# EAGLE schematic Resistor_Resistor (EAGLE 8.3.0), part 2 of 43 (continued)
## Parts (continued)
R2209  10K  RESISTOR_0201  [0201]
R2210  10K  RESISTOR_0201  [0201]
R2211  10K  RESISTOR_0201  [0201]
R2212  10K  RESISTOR_0201  [0201]
R2213  10K  RESISTOR_0201  [0201]
R2214  10K  RESISTOR_0201  [0201]
R2215  10K  RESISTOR_0201  [0201]
R2216  10K  RESISTOR_0201  [0201]
R2217  10K  RESISTOR_0201  [0201]
R2218  10K  RESISTOR_0201  [0201]
R2219  10K  RESISTOR_0201  [0201]
R2220  10K  RESISTOR_0201  [0201]
R2221  10K  RESISTOR_0201  [0201]
R2222  10K  RESISTOR_0201  [0201]
R2223  10K  RESISTOR_0201  [0201]
R2224  10K  RESISTOR_0201  [0201]
R2225  10K  RESISTOR_0201  [0201]
R2226  10K  RESISTOR_0201  [0201]
R2227  10K  RESISTOR_0201  [0201]
R2228  10K  RESISTOR_0201  [0201]
R2229  10K  RESISTOR_0201  [0201]
R2230  10K  RESISTOR_0201  [0201]
R2231  10K  RESISTOR_0201  [0201]
R2232  10K  RESISTOR_0201  [0201]
R2233  10K  RESISTOR_0201  [0201]
R2234  10K  RESISTOR_0201  [0201]
R2235  10K  RESISTOR_0201  [0201]
R2236  10K  RESISTOR_0201  [0201]
R2237  10K  RESISTOR_0201  [0201]
R2238  10K  RESISTOR_0201  [0201]
R2239  10K  RESISTOR_0201  [0201]
R2240  10K  RESISTOR_0201  [0201]
R2241  10K  RESISTOR_0201  [0201]
R2242  10K  RESISTOR_0201  [0201]
R2243  10K  RESISTOR_0201  [0201]
R2244  10K  RESISTOR_0201  [0201]
R2245  10K  RESISTOR_0201  [0201]
R2246  10K  RESISTOR_0201  [0201]
R2247  10K  RESISTOR_0201  [0201]
R2248  10K  RESISTOR_0201  [0201]
R2249  10K  RESISTOR_0201  [0201]
R2250  10K  RESISTOR_0201  [0201]
R2251  10K  RESISTOR_0201  [0201]
R2252  10K  RESISTOR_0201  [0201]
R2253  10K  RESISTOR_0201  [0201]
R2254  10K  RESISTOR_0201  [0201]
R2255  10K  RESISTOR_0201  [0201]
R2256  10K  RESISTOR_0201  [0201]
R2257  10K  RESISTOR_0201  [0201]
R2258  10K  RESISTOR_0201  [0201]
R2259  10K  RESISTOR_0201  [0201]
R2260  10K  RESISTOR_0201  [0201]
R2261  10K  RESISTOR_0201  [0201]
R2262  10K  RESISTOR_0201  [0201]
R2263  10K  RESISTOR_0201  [0201]
R2264  10K  RESISTOR_0201  [0201]
R2265  10K  RESISTOR_0201  [0201]
R2266  10K  RESISTOR_0201  [0201]
R2267  10K  RESISTOR_0201  [0201]
R2268  10K  RESISTOR_0201  [0201]
R2269  10K  RESISTOR_0201  [0201]
R2270  10K  RESISTOR_0201  [0201]
R2271  10K  RESISTOR_0201  [0201]
R2272  10K  RESISTOR_0201  [0201]
R2273  10K  RESISTOR_0201  [0201]
R2274  10K  RESISTOR_0201  [0201]
R2275  10K  RESISTOR_0201  [0201]
R2276  10K  RESISTOR_0201  [0201]
R2277  10K  RESISTOR_0201  [0201]
R2278  10K  RESISTOR_0201  [0201]
R2279  10K  RESISTOR_0201  [0201]
R2280  10K  RESISTOR_0201  [0201]
R2281  10K  RESISTOR_0201  [0201]
R2282  10K  RESISTOR_0201  [0201]
R2283  10K  RESISTOR_0201  [0201]
R2284  10K  RESISTOR_0201  [0201]
R2285  10K  RESISTOR_0201  [0201]
R2286  10K  RESISTOR_0201  [0201]
R2287  10K  RESISTOR_0201  [0201]
R2288  10K  RESISTOR_0201  [0201]
R2289  10K  RESISTOR_0201  [0201]
R2290  10K  RESISTOR_0201  [0201]
R2291  10K  RESISTOR_0201  [0201]
R2292  10K  RESISTOR_0201  [0201]
R2293  10K  RESISTOR_0201  [0201]
R2294  10K  RESISTOR_0201  [0201]
R2295  10K  RESISTOR_0201  [0201]
R2296  10K  RESISTOR_0201  [0201]
R2297  10K  RESISTOR_0201  [0201]
R2298  10K  RESISTOR_0201  [0201]
R2299  10K  RESISTOR_0201  [0201]
R2300  10K  RESISTOR_0201  [0201]
R2301  10K  RESISTOR_0201  [0201]
R2302  10K  RESISTOR_0201  [0201]
R2303  10K  RESISTOR_0201  [0201]
R2304  10K  RESISTOR_0201  [0201]
R2305  10K  RESISTOR_0201  [0201]
R2306  10K  RESISTOR_0201  [0201]
R2307  10K  RESISTOR_0201  [0201]
R2308  10K  RESISTOR_0201  [0201]
R2309  10K  RESISTOR_0201  [0201]
R2310  10K  RESISTOR_0201  [0201]
R2311  10K  RESISTOR_0201  [0201]
R2312  10K  RESISTOR_0201  [0201]
R2313  10K  RESISTOR_0201  [0201]
R2314  10K  RESISTOR_0201  [0201]
R2315  10K  RESISTOR_0201  [0201]
R2316  10K  RESISTOR_0201  [0201]
R2317  10K  RESISTOR_0201  [0201]
R2318  10K  RESISTOR_0201  [0201]
R2319  10K  RESISTOR_0201  [0201]
R2320  10K  RESISTOR_0201  [0201]
R2321  10K  RESISTOR_0201  [0201]
R2322  10K  RESISTOR_0201  [0201]
R2323  10K  RESISTOR_0201  [0201]
R2324  10K  RESISTOR_0201  [0201]
R2325  10K  RESISTOR_0201  [0201]
R2326  10K  RESISTOR_0201  [0201]
R2327  10K  RESISTOR_0201  [0201]
R2328  10K  RESISTOR_0201  [0201]
R2329  10K  RESISTOR_0201  [0201]
R2330  10K  RESISTOR_0201  [0201]
R2331  10K  RESISTOR_0201  [0201]
R2332  10K  RESISTOR_0201  [0201]
R2333  10K  RESISTOR_0201  [0201]
R2334  10K  RESISTOR_0201  [0201]
R2335  10K  RESISTOR_0201  [0201]
R2336  10K  RESISTOR_0201  [0201]
R2337  10K  RESISTOR_0201  [0201]
R2338  10K  RESISTOR_0201  [0201]
R2339  10K  RESISTOR_0201  [0201]
R2340  10K  RESISTOR_0201  [0201]
R2341  10K  RESISTOR_0201  [0201]
R2342  10K  RESISTOR_0201  [0201]
R2343  10K  RESISTOR_0201  [0201]
R2344  10K  RESISTOR_0201  [0201]
R2345  10K  RESISTOR_0201  [0201]
R2346  10K  RESISTOR_0201  [0201]
R2347  10K  RESISTOR_0201  [0201]
R2348  10K  RESISTOR_0201  [0201]
R2349  10K  RESISTOR_0201  [0201]
R2350  10K  RESISTOR_0201  [0201]
R2351  10K  RESISTOR_0201  [0201]
R2352  10K  RESISTOR_0201  [0201]
R2353  10K  RESISTOR_0201  [0201]
R2354  10K  RESISTOR_0201  [0201]
R2355  10K  RESISTOR_0201  [0201]
R2356  10K  RESISTOR_0201  [0201]
R2357  10K  RESISTOR_0201  [0201]
R2358  10K  RESISTOR_0201  [0201]
R2359  10K  RESISTOR_0201  [0201]
R2360  10K  RESISTOR_0201  [0201]
R2361  10K  RESISTOR_0201  [0201]
R2362  10K  RESISTOR_0201  [0201]
R2363  10K  RESISTOR_0201  [0201]
R2364  10K  RESISTOR_0201  [0201]
R2365  10K  RESISTOR_0201  [0201]
R2366  10K  RESISTOR_0201  [0201]
R2367  10K  RESISTOR_0201  [0201]
R2368  10K  RESISTOR_0201  [0201]
R2369  10K  RESISTOR_0201  [0201]
R2370  10K  RESISTOR_0201  [0201]
R2371  10K  RESISTOR_0201  [0201]
R2372  10K  RESISTOR_0201  [0201]
R2373  10K  RESISTOR_0201  [0201]
R2374  10K  RESISTOR_0201  [0201]
R2375  10K  RESISTOR_0201  [0201]
R2376  10K  RESISTOR_0201  [0201]
R2377  10K  RESISTOR_0201  [0201]
R2378  10K  RESISTOR_0201  [0201]
R2379  10K  RESISTOR_0201  [0201]
R2380  10K  RESISTOR_0201  [0201]
R2381  10K  RESISTOR_0201  [0201]
R2382  10K  RESISTOR_0201  [0201]
R2383  10K  RESISTOR_0201  [0201]
R2384  10K  RESISTOR_0201  [0201]
R2385  10K  RESISTOR_0201  [0201]
R2386  10K  RESISTOR_0201  [0201]
R2387  10K  RESISTOR_0201  [0201]
R2388  10K  RESISTOR_0201  [0201]
R2389  10K  RESISTOR_0201  [0201]
R2390  10K  RESISTOR_0201  [0201]
R2391  10K  RESISTOR_0201  [0201]
R2392  10K  RESISTOR_0201  [0201]
R2393  10K  RESISTOR_0201  [0201]
R2394  10K  RESISTOR_0201  [0201]
R2395  10K  RESISTOR_0201  [0201]
R2396  10K  RESISTOR_0201  [0201]
R2397  10K  RESISTOR_0201  [0201]
R2398  10K  RESISTOR_0201  [0201]
R2399  10K  RESISTOR_0201  [0201]
R2400  10K  RESISTOR_0201  [0201]
R2401  10K  RESISTOR_0201  [0201]
R2402  10K  RESISTOR_0201  [0201]
R2403  10K  RESISTOR_0201  [0201]
R2404  10K  RESISTOR_0201  [0201]
R2405  10K  RESISTOR_0201  [0201]
R2406  10K  RESISTOR_0201  [0201]
R2407  10K  RESISTOR_0201  [0201]
R2408  10K  RESISTOR_0201  [0201]
R2409  10K  RESISTOR_0201  [0201]
R2410  10K  RESISTOR_0201  [0201]
R2411  10K  RESISTOR_0201  [0201]
R2412  10K  RESISTOR_0201  [0201]
R2413  10K  RESISTOR_0201  [0201]
R2414  10K  RESISTOR_0201  [0201]
R2415  10K  RESISTOR_0201  [0201]
R2416  10K  RESISTOR_0201  [0201]
R2417  10K  RESISTOR_0201  [0201]
R2418  10K  RESISTOR_0201  [0201]
R2419  10K  RESISTOR_0201  [0201]
R2420  10K  RESISTOR_0201  [0201]
R2421  10K  RESISTOR_0201  [0201]
R2422  10K  RESISTOR_0201  [0201]
R2423  10K  RESISTOR_0201  [0201]
R2424  10K  RESISTOR_0201  [0201]
R2425  10K  RESISTOR_0201  [0201]
R2426  10K  RESISTOR_0201  [0201]
R2427  10K  RESISTOR_0201  [0201]
R2428  10K  RESISTOR_0201  [0201]
R2429  10K  RESISTOR_0201  [0201]
R2430  10K  RESISTOR_0201  [0201]
R2431  10K  RESISTOR_0201  [0201]
R2432  10K  RESISTOR_0201  [0201]
R2433  10K  RESISTOR_0201  [0201]
R2434  10K  RESISTOR_0201  [0201]
R2435  10K  RESISTOR_0201  [0201]
R2436  10K  RESISTOR_0201  [0201]
R2437  10K  RESISTOR_0201  [0201]
R2438  10K  RESISTOR_0201  [0201]
R2439  10K  RESISTOR_0201  [0201]
R2440  10K  RESISTOR_0201  [0201]
R2441  10K  RESISTOR_0201  [0201]
R2442  10K  RESISTOR_0201  [0201]
R2443  10K  RESISTOR_0201  [0201]
R2444  10K  RESISTOR_0201  [0201]
R2445  10K  RESISTOR_0201  [0201]
R2446  10K  RESISTOR_0201  [0201]
R2447  10K  RESISTOR_0201  [0201]
R2448  10K  RESISTOR_0201  [0201]
R2449  10K  RESISTOR_0201  [0201]
R2450  10K  RESISTOR_0201  [0201]
R2451  10K  RESISTOR_0201  [0201]
R2452  10K  RESISTOR_0201  [0201]
R2453  10K  RESISTOR_0201  [0201]
R2454  10K  RESISTOR_0201  [0201]
R2455  10K  RESISTOR_0201  [0201]
R2456  10K  RESISTOR_0201  [0201]
R2457  10K  RESISTOR_0201  [0201]
R2458  10K  RESISTOR_0201  [0201]
R2459  10K  RESISTOR_0201  [0201]
R2460  10K  RESISTOR_0201  [0201]
R2461  10K  RESISTOR_0201  [0201]
R2462  10K  RESISTOR_0201  [0201]
R2463  10K  RESISTOR_0201  [0201]
R2464  10K  RESISTOR_0201  [0201]
R2465  10K  RESISTOR_0201  [0201]
R2466  10K  RESISTOR_0201  [0201]
R2467  10K  RESISTOR_0201  [0201]
R2468  10K  RESISTOR_0201  [0201]
R2469  10K  RESISTOR_0201  [0201]
R2470  10K  RESISTOR_0201  [0201]
R2471  10K  RESISTOR_0201  [0201]
R2472  10K  RESISTOR_0201  [0201]
R2473  10K  RESISTOR_0201  [0201]
R2474  10K  RESISTOR_0201  [0201]
R2475  10K  RESISTOR_0201  [0201]
R2476  10K  RESISTOR_0201  [0201]
R2477  10K  RESISTOR_0201  [0201]
R2478  10K  RESISTOR_0201  [0201]
R2479  10K  RESISTOR_0201  [0201]
R2480  10K  RESISTOR_0201  [0201]
R2481  10K  RESISTOR_0201  [0201]
R2482  10K  RESISTOR_0201  [0201]
R2483  10K  RESISTOR_0201  [0201]
R2484  10K  RESISTOR_0201  [0201]
R2485  10K  RESISTOR_0201  [0201]
R2486  10K  RESISTOR_0201  [0201]
R2487  10K  RESISTOR_0201  [0201]
R2488  10K  RESISTOR_0201  [0201]
R2489  10K  RESISTOR_0201  [0201]
R2490  10K  RESISTOR_0201  [0201]
R2491  10K  RESISTOR_0201  [0201]
R2492  10K  RESISTOR_0201  [0201]
R2493  10K  RESISTOR_0201  [0201]
R2494  10K  RESISTOR_0201  [0201]
R2495  10K  RESISTOR_0201  [0201]
R2496  10K  RESISTOR_0201  [0201]
R2497  10K  RESISTOR_0201  [0201]
R2498  10K  RESISTOR_0201  [0201]
R2499  10K  RESISTOR_0201  [0201]
R2500  10K  RESISTOR_0201  [0201]
R2501  10K  RESISTOR_0201  [0201]
R2502  10K  RESISTOR_0201  [0201]
R2503  10K  RESISTOR_0201  [0201]
R2504  10K  RESISTOR_0201  [0201]
R2505  10K  RESISTOR_0201  [0201]
R2506  10K  RESISTOR_0201  [0201]
R2507  10K  RESISTOR_0201  [0201]
R2508  10K  RESISTOR_0201  [0201]
R2509  10K  RESISTOR_0201  [0201]
R2510  10K  RESISTOR_0201  [0201]
R2511  10K  RESISTOR_0201  [0201]
R2512  10K  RESISTOR_0201  [0201]
R2513  10K  RESISTOR_0201  [0201]
R2514  10K  RESISTOR_0201  [0201]
R2515  10K  RESISTOR_0201  [0201]
R2516  10K  RESISTOR_0201  [0201]
R2517  10K  RESISTOR_0201  [0201]
R2518  10K  RESISTOR_0201  [0201]
R2519  10K  RESISTOR_0201  [0201]
R2520  10K  RESISTOR_0201  [0201]
R2521  10K  RESISTOR_0201  [0201]
R2522  10K  RESISTOR_0201  [0201]
R2523  10K  RESISTOR_0201  [0201]
R2524  10K  RESISTOR_0201  [0201]
R2525  10K  RESISTOR_0201  [0201]
R2526  10K  RESISTOR_0201  [0201]
R2527  10K  RESISTOR_0201  [0201]
R2528  10K  RESISTOR_0201  [0201]
R2529  10K  RESISTOR_0201  [0201]
R2530  10K  RESISTOR_0201  [0201]
R2531  10K  RESISTOR_0201  [0201]
R2532  10K  RESISTOR_0201  [0201]
R2533  10K  RESISTOR_0201  [0201]
R2534  10K  RESISTOR_0201  [0201]
R2535  10K  RESISTOR_0201  [0201]
R2536  10K  RESISTOR_0201  [0201]
R2537  10K  RESISTOR_0201  [0201]
R2538  10K  RESISTOR_0201  [0201]
R2539  10K  RESISTOR_0201  [0201]
R2540  10K  RESISTOR_0201  [0201]
R2541  10K  RESISTOR_0201  [0201]
R2542  10K  RESISTOR_0201  [0201]
R2543  10K  RESISTOR_0201  [0201]
R2544  10K  RESISTOR_0201  [0201]
R2545  10K  RESISTOR_0201  [0201]
R2546  10K  RESISTOR_0201  [0201]
R2547  10K  RESISTOR_0201  [0201]
R2548  10K  RESISTOR_0201  [0201]
R2549  10K  RESISTOR_0201  [0201]
R2550  10K  RESISTOR_0201  [0201]
R2551  10K  RESISTOR_0201  [0201]
R2552  10K  RESISTOR_0201  [0201]
R2553  10K  RESISTOR_0201  [0201]
R2554  10K  RESISTOR_0201  [0201]
R2555  10K  RESISTOR_0201  [0201]
R2556  10K  RESISTOR_0201  [0201]
R2557  10K  RESISTOR_0201  [0201]
R2558  10K  RESISTOR_0201  [0201]
R2559  10K  RESISTOR_0201  [0201]
R2560  10K  RESISTOR_0201  [0201]
R2561  10K  RESISTOR_0201  [0201]
R2562  10K  RESISTOR_0201  [0201]
R2563  10K  RESISTOR_0201  [0201]
R2564  10K  RESISTOR_0201  [0201]
R2565  10K  RESISTOR_0201  [0201]
R2566  10K  RESISTOR_0201  [0201]
R2567  10K  RESISTOR_0201  [0201]
R2568  10K  RESISTOR_0201  [0201]
R2569  10K  RESISTOR_0201  [0201]
R2570  10K  RESISTOR_0201  [0201]
R2571  10K  RESISTOR_0201  [0201]
R2572  10K  RESISTOR_0201  [0201]
R2573  10K  RESISTOR_0201  [0201]
R2574  10K  RESISTOR_0201  [0201]
R2575  10K  RESISTOR_0201  [0201]
R2576  10K  RESISTOR_0201  [0201]
R2577  10K  RESISTOR_0201  [0201]
R2578  10K  RESISTOR_0201  [0201]
R2579  10K  RESISTOR_0201  [0201]
R2580  10K  RESISTOR_0201  [0201]
R2581  10K  RESISTOR_0201  [0201]
R2582  10K  RESISTOR_0201  [0201]
R2583  10K  RESISTOR_0201  [0201]
R2584  10K  RESISTOR_0201  [0201]
R2585  10K  RESISTOR_0201  [0201]
R2586  10K  RESISTOR_0201  [0201]
R2587  10K  RESISTOR_0201  [0201]
R2588  10K  RESISTOR_0201  [0201]
R2589  10K  RESISTOR_0201  [0201]
R2590  10K  RESISTOR_0201  [0201]
R2591  10K  RESISTOR_0201  [0201]
R2592  10K  RESISTOR_0201  [0201]
R2593  10K  RESISTOR_0201  [0201]
R2594  10K  RESISTOR_0201  [0201]
R2595  10K  RESISTOR_0201  [0201]
R2596  10K  RESISTOR_0201  [0201]
R2597  10K  RESISTOR_0201  [0201]
R2598  10K  RESISTOR_0201  [0201]
R2599  10K  RESISTOR_0201  [0201]
R2600  10K  RESISTOR_0201  [0201]
R2601  10K  RESISTOR_0201  [0201]
R2602  10K  RESISTOR_0201  [0201]
R2603  10K  RESISTOR_0201  [0201]
R2604  10K  RESISTOR_0201  [0201]
R2605  10K  RESISTOR_0201  [0201]
R2606  10K  RESISTOR_0201  [0201]
R2607  10K  RESISTOR_0201  [0201]
R2608  10K  RESISTOR_0201  [0201]
R2609  10K  RESISTOR_0201  [0201]
R2610  10K  RESISTOR_0201  [0201]
R2611  10K  RESISTOR_0201  [0201]
R2612  10K  RESISTOR_0201  [0201]
R2613  10K  RESISTOR_0201  [0201]
R2614  10K  RESISTOR_0201  [0201]
R2615  10K  RESISTOR_0201  [0201]
R2616  10K  RESISTOR_0201  [0201]
R2617  10K  RESISTOR_0201  [0201]
R2618  10K  RESISTOR_0201  [0201]
R2619  10K  RESISTOR_0201  [0201]
R2620  10K  RESISTOR_0201  [0201]
R2621  10K  RESISTOR_0201  [0201]
R2622  10K  RESISTOR_0201  [0201]
R2623  10K  RESISTOR_0201  [0201]
R2624  10K  RESISTOR_0201  [0201]
R2625  10K  RESISTOR_0201  [0201]
R2626  10K  RESISTOR_0201  [0201]
R2627  10K  RESISTOR_0201  [0201]
R2628  10K  RESISTOR_0201  [0201]
R2629  10K  RESISTOR_0201  [0201]
R2630  10K  RESISTOR_0201  [0201]
R2631  10K  RESISTOR_0201  [0201]
R2632  10K  RESISTOR_0201  [0201]
R2633  10K  RESISTOR_0201  [0201]
R2634  10K  RESISTOR_0201  [0201]
R2635  10K  RESISTOR_0201  [0201]
R2636  10K  RESISTOR_0201  [0201]
R2637  10K  RESISTOR_0201  [0201]
R2638  10K  RESISTOR_0201  [0201]
R2639  10K  RESISTOR_0201  [0201]
R2640  10K  RESISTOR_0201  [0201]
R2641  10K  RESISTOR_0201  [0201]
R2642  10K  RESISTOR_0201  [0201]
R2643  10K  RESISTOR_0201  [0201]
R2644  10K  RESISTOR_0201  [0201]
R2645  10K  RESISTOR_0201  [0201]
R2646  10K  RESISTOR_0201  [0201]
R2647  10K  RESISTOR_0201  [0201]
R2648  10K  RESISTOR_0201  [0201]
R2649  10K  RESISTOR_0201  [0201]
R2650  10K  RESISTOR_0201  [0201]
R2651  10K  RESISTOR_0201  [0201]
R2652  10K  RESISTOR_0201  [0201]
R2653  10K  RESISTOR_0201  [0201]
R2654  10K  RESISTOR_0201  [0201]
R2655  10K  RESISTOR_0201  [0201]
R2656  10K  RESISTOR_0201  [0201]
R2657  10K  RESISTOR_0201  [0201]
R2658  10K  RESISTOR_0201  [0201]
R2659  10K  RESISTOR_0201  [0201]
R2660  10K  RESISTOR_0201  [0201]
R2661  10K  RESISTOR_0201  [0201]
R2662  10K  RESISTOR_0201  [0201]
R2663  10K  RESISTOR_0201  [0201]
R2664  10K  RESISTOR_0201  [0201]
R2665  10K  RESISTOR_0201  [0201]
R2666  10K  RESISTOR_0201  [0201]
R2667  10K  RESISTOR_0201  [0201]
R2668  10K  RESISTOR_0201  [0201]
R2669  10K  RESISTOR_0201  [0201]
R2670  10K  RESISTOR_0201  [0201]
R2671  10K  RESISTOR_0201  [0201]
R2672  10K  RESISTOR_0201  [0201]
R2673  10K  RESISTOR_0201  [0201]
R2674  10K  RESISTOR_0201  [0201]
R2675  10K  RESISTOR_0201  [0201]
R2676  10K  RESISTOR_0201  [0201]
R2677  10K  RESISTOR_0201  [0201]
R2678  10K  RESISTOR_0201  [0201]
R2679  10K  RESISTOR_0201  [0201]
R2680  10K  RESISTOR_0201  [0201]
R2681  10K  RESISTOR_0201  [0201]
R2682  10K  RESISTOR_0201  [0201]
R2683  10K  RESISTOR_0201  [0201]
R2684  10K  RESISTOR_0201  [0201]
R2685  10K  RESISTOR_0201  [0201]
R2686  10K  RESISTOR_0201  [0201]
R2687  10K  RESISTOR_0201  [0201]
R2688  10K  RESISTOR_0201  [0201]
R2689  10K  RESISTOR_0201  [0201]
R2690  10K  RESISTOR_0201  [0201]
R2691  10K  RESISTOR_0201  [0201]
R2692  10K  RESISTOR_0201  [0201]
R2693  10K  RESISTOR_0201  [0201]
R2694  10K  RESISTOR_0201  [0201]
R2695  10K  RESISTOR_0201  [0201]
R2696  10K  RESISTOR_0201  [0201]
R2697  10K  RESISTOR_0201  [0201]
R2698  10K  RESISTOR_0201  [0201]
R2699  10K  RESISTOR_0201  [0201]
R2700  10K  RESISTOR_0201  [0201]
R2701  10K  RESISTOR_0201  [0201]
R2702  10K  RESISTOR_0201  [0201]
R2703  10K  RESISTOR_0201  [0201]
R2704  10K  RESISTOR_0201  [0201]
R2705  10K  RESISTOR_0201  [0201]
R2706  10K  RESISTOR_0201  [0201]
R2707  10K  RESISTOR_0201  [0201]
R2708  10K  RESISTOR_0201  [0201]
R2709  10K  RESISTOR_0201  [0201]
R2710  10K  RESISTOR_0201  [0201]
R2711  10K  RESISTOR_0201  [0201]
R2712  10K  RESISTOR_0201  [0201]
R2713  10K  RESISTOR_0201  [0201]
R2714  10K  RESISTOR_0201  [0201]
R2715  10K  RESISTOR_0201  [0201]
R2716  10K  RESISTOR_0201  [0201]
R2717  10K  RESISTOR_0201  [0201]
R2718  10K  RESISTOR_0201  [0201]
R2719  10K  RESISTOR_0201  [0201]
R2720  10K  RESISTOR_0201  [0201]
R2721  10K  RESISTOR_0201  [0201]
R2722  10K  RESISTOR_0201  [0201]
R2723  10K  RESISTOR_0201  [0201]
R2724  10K  RESISTOR_0201  [0201]
R2725  10K  RESISTOR_0201  [0201]
R2726  10K  RESISTOR_0201  [0201]
R2727  10K  RESISTOR_0201  [0201]
R2728  10K  RESISTOR_0201  [0201]
R2729  10K  RESISTOR_0201  [0201]
R2730  10K  RESISTOR_0201  [0201]
R2731  10K  RESISTOR_0201  [0201]
R2732  10K  RESISTOR_0201  [0201]
R2733  10K  RESISTOR_0201  [0201]
R2734  10K  RESISTOR_0201  [0201]
R2735  10K  RESISTOR_0201  [0201]
R2736  10K  RESISTOR_0201  [0201]
R2737  10K  RESISTOR_0201  [0201]
R2738  10K  RESISTOR_0201  [0201]
R2739  10K  RESISTOR_0201  [0201]
R2740  10K  RESISTOR_0201  [0201]
R2741  10K  RESISTOR_0201  [0201]
R2742  10K  RESISTOR_0201  [0201]
R2743  10K  RESISTOR_0201  [0201]
R2744  10K  RESISTOR_0201  [0201]
R2745  10K  RESISTOR_0201  [0201]
R2746  10K  RESISTOR_0201  [0201]
R2747  10K  RESISTOR_0201  [0201]
R2748  10K  RESISTOR_0201  [0201]
R2749  10K  RESISTOR_0201  [0201]
R2750  10K  RESISTOR_0201  [0201]
R2751  10K  RESISTOR_0201  [0201]
R2752  10K  RESISTOR_0201  [0201]
R2753  10K  RESISTOR_0201  [0201]
R2754  10K  RESISTOR_0201  [0201]
R2755  10K  RESISTOR_0201  [0201]
R2756  10K  RESISTOR_0201  [0201]
R2757  10K  RESISTOR_0201  [0201]
R2758  10K  RESISTOR_0201  [0201]
R2759  10K  RESISTOR_0201  [0201]
R2760  10K  RESISTOR_0201  [0201]
R2761  10K  RESISTOR_0201  [0201]
R2762  10K  RESISTOR_0201  [0201]
R2763  10K  RESISTOR_0201  [0201]
R2764  10K  RESISTOR_0201  [0201]
R2765  10K  RESISTOR_0201  [0201]
R2766  10K  RESISTOR_0201  [0201]
R2767  10K  RESISTOR_0201  [0201]
R2768  10K  RESISTOR_0201  [0201]
R2769  10K  RESISTOR_0201  [0201]
R2770  10K  RESISTOR_0201  [0201]
R2771  10K  RESISTOR_0201  [0201]
R2772  10K  RESISTOR_0201  [0201]
R2773  10K  RESISTOR_0201  [0201]
R2774  10K  RESISTOR_0201  [0201]
R2775  10K  RESISTOR_0201  [0201]
R2776  10K  RESISTOR_0201  [0201]
R2777  10K  RESISTOR_0201  [0201]
R2778  10K  RESISTOR_0201  [0201]
R2779  10K  RESISTOR_0201  [0201]
R2780  10K  RESISTOR_0201  [0201]
R2781  10K  RESISTOR_0201  [0201]
R2782  10K  RESISTOR_0201  [0201]
R2783  10K  RESISTOR_0201  [0201]
R2784  10K  RESISTOR_0201  [0201]
R2785  10K  RESISTOR_0201  [0201]
R2786  10K  RESISTOR_0201  [0201]
R2787  10K  RESISTOR_0201  [0201]
R2788  10K  RESISTOR_0201  [0201]
R2789  10K  RESISTOR_0201  [0201]
R2790  10K  RESISTOR_0201  [0201]
R2791  10K  RESISTOR_0201  [0201]
R2792  10K  RESISTOR_0201  [0201]
R2793  10K  RESISTOR_0201  [0201]
R2794  10K  RESISTOR_0201  [0201]
R2795  10K  RESISTOR_0201  [0201]
R2796  10K  RESISTOR_0201  [0201]
R2797  10K  RESISTOR_0201  [0201]
R2798  10K  RESISTOR_0201  [0201]
R2799  10K  RESISTOR_0201  [0201]
R2800  10K  RESISTOR_0201  [0201]
R2801  10K  RESISTOR_0201  [0201]
R2802  10K  RESISTOR_0201  [0201]
R2803  10K  RESISTOR_0201  [0201]
R2804  10K  RESISTOR_0201  [0201]
R2805  10K  RESISTOR_0201  [0201]
R2806  10K  RESISTOR_0201  [0201]
R2807  10K  RESISTOR_0201  [0201]
R2808  10K  RESISTOR_0201  [0201]
R2809  10K  RESISTOR_0201  [0201]
R2810  10K  RESISTOR_0201  [0201]
R2811  10K  RESISTOR_0201  [0201]
R2812  10K  RESISTOR_0201  [0201]
R2813  10K  RESISTOR_0201  [0201]
R2814  10K  RESISTOR_0201  [0201]
R2815  10K  RESISTOR_0201  [0201]
R2816  10K  RESISTOR_0201  [0201]
R2817  10K  RESISTOR_0201  [0201]
R2818  10K  RESISTOR_0201  [0201]
R2819  10K  RESISTOR_0201  [0201]
R2820  10K  RESISTOR_0201  [0201]
R2821  10K  RESISTOR_0201  [0201]
R2822  10K  RESISTOR_0201  [0201]
R2823  10K  RESISTOR_0201  [0201]
R2824  10K  RESISTOR_0201  [0201]
R2825  10K  RESISTOR_0201  [0201]
R2826  10K  RESISTOR_0201  [0201]
R2827  10K  RESISTOR_0201  [0201]
R2828  10K  RESISTOR_0201  [0201]
R2829  10K  RESISTOR_0201  [0201]
R2830  10K  RESISTOR_0201  [0201]
R2831  10K  RESISTOR_0201  [0201]
R2832  10K  RESISTOR_0201  [0201]
R2833  10K  RESISTOR_0201  [0201]
R2834  10K  RESISTOR_0201  [0201]
R2835  10K  RESISTOR_0201  [0201]
R2836  10K  RESISTOR_0201  [0201]
R2837  10K  RESISTOR_0201  [0201]
R2838  10K  RESISTOR_0201  [0201]
R2839  10K  RESISTOR_0201  [0201]
R2840  10K  RESISTOR_0201  [0201]
R2841  10K  RESISTOR_0201  [0201]
R2842  10K  RESISTOR_0201  [0201]
R2843  10K  RESISTOR_0201  [0201]
R2844  10K  RESISTOR_0201  [0201]
R2845  10K  RESISTOR_0201  [0201]
R2846  10K  RESISTOR_0201  [0201]
R2847  10K  RESISTOR_0201  [0201]
R2848  10K  RESISTOR_0201  [0201]
R2849  10K  RESISTOR_0201  [0201]
R2850  10K  RESISTOR_0201  [0201]
R2851  10K  RESISTOR_0201  [0201]
R2852  10K  RESISTOR_0201  [0201]
R2853  10K  RESISTOR_0201  [0201]
R2854  10K  RESISTOR_0201  [0201]
R2855  10K  RESISTOR_0201  [0201]
R2856  10K  RESISTOR_0201  [0201]
R2857  10K  RESISTOR_0201  [0201]
R2858  10K  RESISTOR_0201  [0201]
R2859  10K  RESISTOR_0201  [0201]
R2860  10K  RESISTOR_0201  [0201]
R2861  10K  RESISTOR_0201  [0201]
R2862  10K  RESISTOR_0201  [0201]
R2863  10K  RESISTOR_0201  [0201]
R2864  10K  RESISTOR_0201  [0201]
R2865  10K  RESISTOR_0201  [0201]
R2866  10K  RESISTOR_0201  [0201]
R2867  10K  RESISTOR_0201  [0201]
R2868  10K  RESISTOR_0201  [0201]
R2869  10K  RESISTOR_0201  [0201]
R2870  10K  RESISTOR_0201  [0201]
R2871  10K  RESISTOR_0201  [0201]
R2872  10K  RESISTOR_0201  [0201]
R2873  10K  RESISTOR_0201  [0201]
R2874  10K  RESISTOR_0201  [0201]
R2875  10K  RESISTOR_0201  [0201]
R2876  10K  RESISTOR_0201  [0201]
R2877  10K  RESISTOR_0201  [0201]
R2878  10K  RESISTOR_0201  [0201]
R2879  10K  RESISTOR_0201  [0201]
R2880  10K  RESISTOR_0201  [0201]
R2881  10K  RESISTOR_0201  [0201]
R2882  10K  RESISTOR_0201  [0201]
R2883  10K  RESISTOR_0201  [0201]
R2884  10K  RESISTOR_0201  [0201]
R2885  10K  RESISTOR_0201  [0201]
R2886  10K  RESISTOR_0201  [0201]
R2887  10K  RESISTOR_0201  [0201]
R2888  10K  RESISTOR_0201  [0201]
R2889  10K  RESISTOR_0201  [0201]
R2890  10K  RESISTOR_0201  [0201]
R2891  10K  RESISTOR_0201  [0201]
R2892  10K  RESISTOR_0201  [0201]
R2893  10K  RESISTOR_0201  [0201]
R2894  10K  RESISTOR_0201  [0201]
R2895  10K  RESISTOR_0201  [0201]
R2896  10K  RESISTOR_0201  [0201]
R2897  10K  RESISTOR_0201  [0201]
R2898  10K  RESISTOR_0201  [0201]
R2899  10K  RESISTOR_0201  [0201]
R2900  10K  RESISTOR_0201  [0201]
R2901  10K  RESISTOR_0201  [0201]
R2902  10K  RESISTOR_0201  [0201]
R2903  10K  RESISTOR_0201  [0201]
R2904  10K  RESISTOR_0201  [0201]
R2905  10K  RESISTOR_0201  [0201]
R2906  10K  RESISTOR_0201  [0201]
R2907  10K  RESISTOR_0201  [0201]
R2908  10K  RESISTOR_0201  [0201]
R2909  10K  RESISTOR_0201  [0201]
R2910  10K  RESISTOR_0201  [0201]
R2911  10K  RESISTOR_0201  [0201]
R2912  10K  RESISTOR_0201  [0201]
R2913  10K  RESISTOR_0201  [0201]
R2914  10K  RESISTOR_0201  [0201]
R2915  10K  RESISTOR_0201  [0201]
R2916  10K  RESISTOR_0201  [0201]
R2917  10K  RESISTOR_0201  [0201]
R2918  10K  RESISTOR_0201  [0201]
R2919  10K  RESISTOR_0201  [0201]
R2920  10K  RESISTOR_0201  [0201]
R2921  10K  RESISTOR_0201  [0201]
R2922  10K  RESISTOR_0201  [0201]
R2923  10K  RESISTOR_0201  [0201]
R2924  10K  RESISTOR_0201  [0201]
R2925  10K  RESISTOR_0201  [0201]
R2926  10K  RESISTOR_0201  [0201]
R2927  10K  RESISTOR_0201  [0201]
R2928  10K  RESISTOR_0201  [0201]
R2929  10K  RESISTOR_0201  [0201]
R2930  10K  RESISTOR_0201  [0201]
R2931  10K  RESISTOR_0201  [0201]
R2932  10K  RESISTOR_0201  [0201]
R2933  10K  RESISTOR_0201  [0201]
R2934  10K  RESISTOR_0201  [0201]
R2935  10K  RESISTOR_0201  [0201]
R2936  10K  RESISTOR_0201  [0201]
R2937  10K  RESISTOR_0201  [0201]
R2938  10K  RESISTOR_0201  [0201]
R2939  10K  RESISTOR_0201  [0201]